# Altium schematic sheet Array.SchDoc (part 2 of 3)
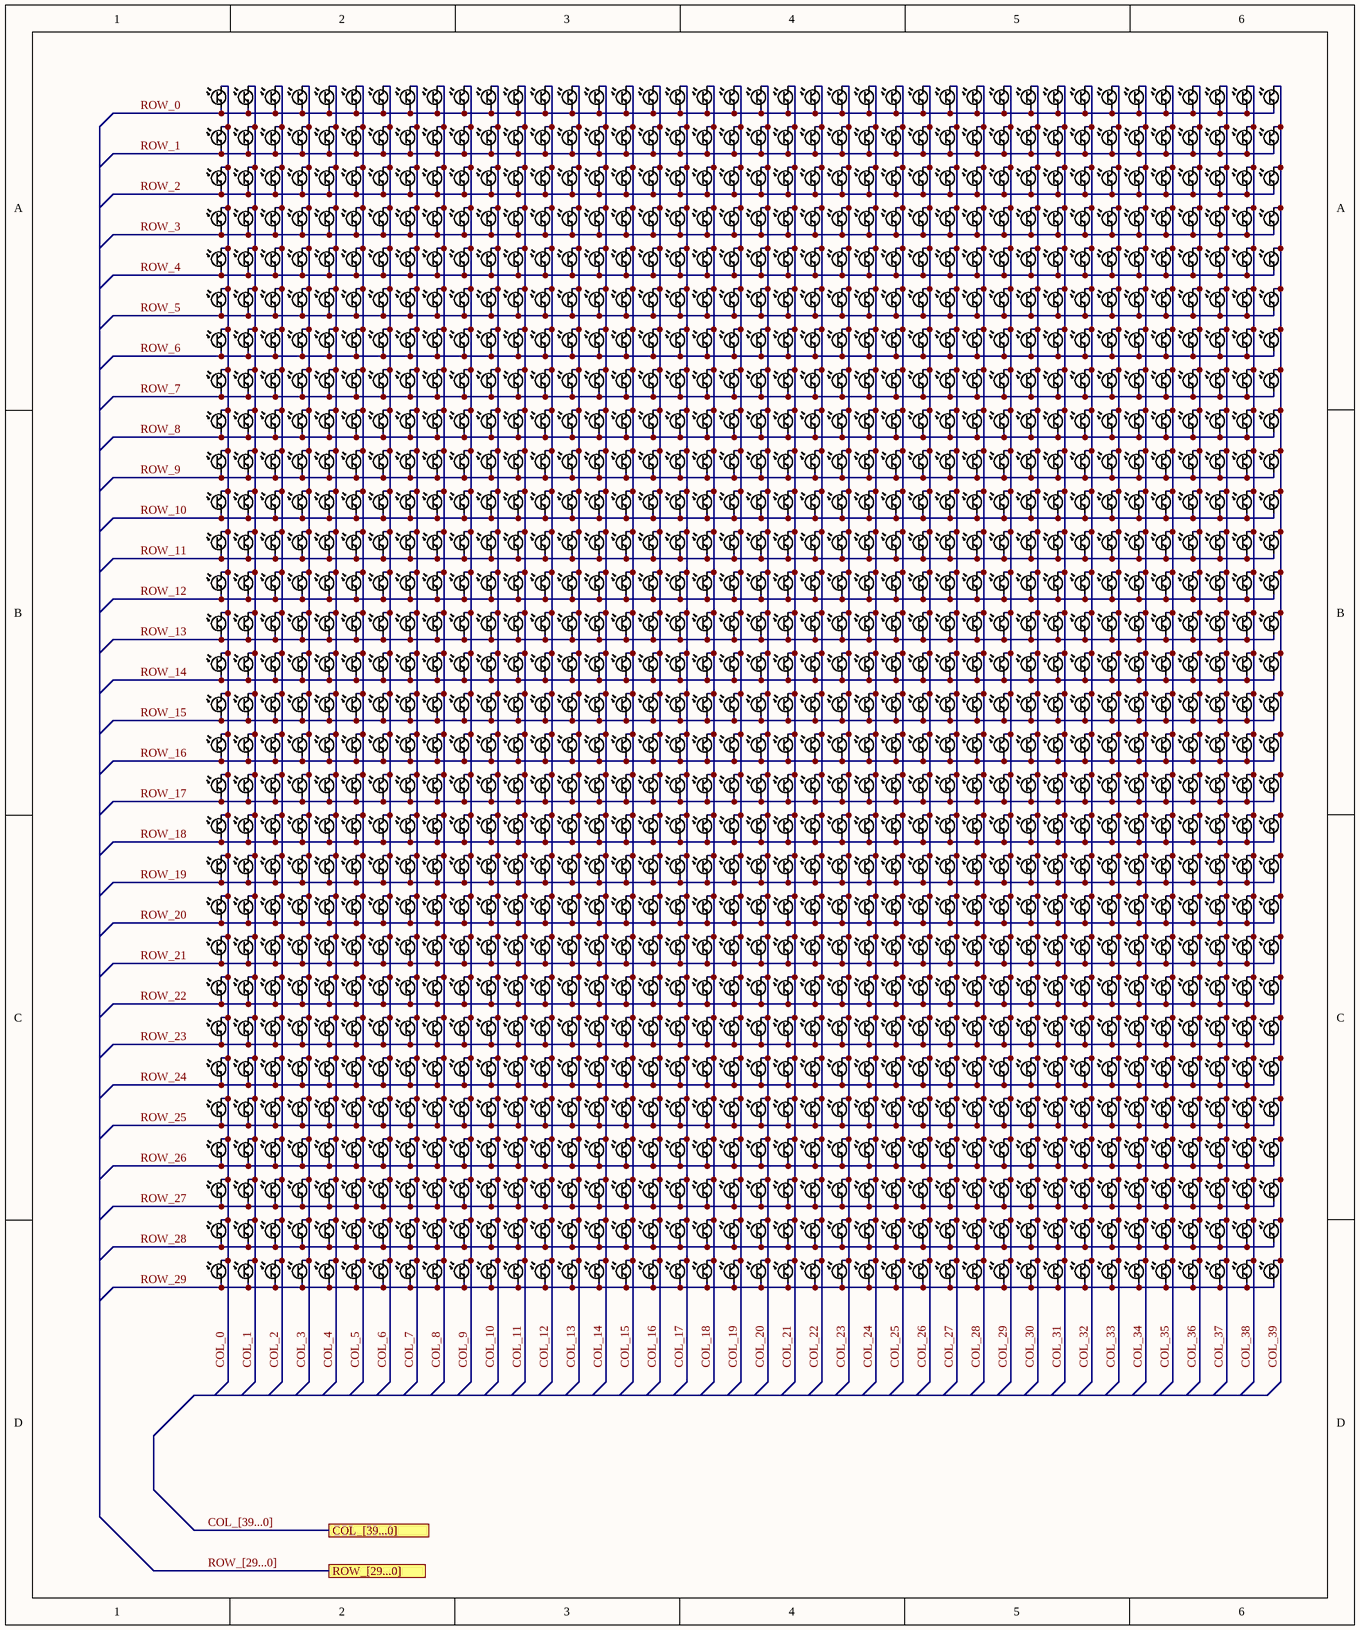
[diagram p1: Array.SchDoc]
## Parts
Q1  PT0805CS  [0805 Phototransistor]  (value not drawn)
Q2  PT0805CS  [0805 Phototransistor]  (value not drawn)
Q3  PT0805CS  [0805 Phototransistor]  (value not drawn)
Q4  PT0805CS  [0805 Phototransistor]  (value not drawn)
Q5  PT0805CS  [0805 Phototransistor]  (value not drawn)
Q6  PT0805CS  [0805 Phototransistor]  (value not drawn)
Q7  PT0805CS  [0805 Phototransistor]  (value not drawn)
Q8  PT0805CS  [0805 Phototransistor]  (value not drawn)
Q9  PT0805CS  [0805 Phototransistor]  (value not drawn)
Q10  PT0805CS  [0805 Phototransistor]  (value not drawn)
Q11  PT0805CS  [0805 Phototransistor]  (value not drawn)
Q12  PT0805CS  [0805 Phototransistor]  (value not drawn)
Q13  PT0805CS  [0805 Phototransistor]  (value not drawn)
Q14  PT0805CS  [0805 Phototransistor]  (value not drawn)
Q15  PT0805CS  [0805 Phototransistor]  (value not drawn)
Q16  PT0805CS  [0805 Phototransistor]  (value not drawn)
Q17  PT0805CS  [0805 Phototransistor]  (value not drawn)
Q18  PT0805CS  [0805 Phototransistor]  (value not drawn)
Q19  PT0805CS  [0805 Phototransistor]  (value not drawn)
Q20  PT0805CS  [0805 Phototransistor]  (value not drawn)
Q21  PT0805CS  [0805 Phototransistor]  (value not drawn)
Q22  PT0805CS  [0805 Phototransistor]  (value not drawn)
Q23  PT0805CS  [0805 Phototransistor]  (value not drawn)
Q24  PT0805CS  [0805 Phototransistor]  (value not drawn)
Q25  PT0805CS  [0805 Phototransistor]  (value not drawn)
Q26  PT0805CS  [0805 Phototransistor]  (value not drawn)
Q27  PT0805CS  [0805 Phototransistor]  (value not drawn)
Q28  PT0805CS  [0805 Phototransistor]  (value not drawn)
Q29  PT0805CS  [0805 Phototransistor]  (value not drawn)
Q30  PT0805CS  [0805 Phototransistor]  (value not drawn)
Q31  PT0805CS  [0805 Phototransistor]  (value not drawn)
Q32  PT0805CS  [0805 Phototransistor]  (value not drawn)
Q33  PT0805CS  [0805 Phototransistor]  (value not drawn)
Q34  PT0805CS  [0805 Phototransistor]  (value not drawn)
Q35  PT0805CS  [0805 Phototransistor]  (value not drawn)
Q36  PT0805CS  [0805 Phototransistor]  (value not drawn)
Q37  PT0805CS  [0805 Phototransistor]  (value not drawn)
Q38  PT0805CS  [0805 Phototransistor]  (value not drawn)
Q39  PT0805CS  [0805 Phototransistor]  (value not drawn)
Q40  PT0805CS  [0805 Phototransistor]  (value not drawn)
Q41  PT0805CS  [0805 Phototransistor]  (value not drawn)
Q42  PT0805CS  [0805 Phototransistor]  (value not drawn)
Q43  PT0805CS  [0805 Phototransistor]  (value not drawn)
Q44  PT0805CS  [0805 Phototransistor]  (value not drawn)
Q45  PT0805CS  [0805 Phototransistor]  (value not drawn)
Q46  PT0805CS  [0805 Phototransistor]  (value not drawn)
Q47  PT0805CS  [0805 Phototransistor]  (value not drawn)
Q48  PT0805CS  [0805 Phototransistor]  (value not drawn)
Q49  PT0805CS  [0805 Phototransistor]  (value not drawn)
Q50  PT0805CS  [0805 Phototransistor]  (value not drawn)
Q51  PT0805CS  [0805 Phototransistor]  (value not drawn)
Q52  PT0805CS  [0805 Phototransistor]  (value not drawn)
Q53  PT0805CS  [0805 Phototransistor]  (value not drawn)
Q54  PT0805CS  [0805 Phototransistor]  (value not drawn)
Q55  PT0805CS  [0805 Phototransistor]  (value not drawn)
Q56  PT0805CS  [0805 Phototransistor]  (value not drawn)
Q57  PT0805CS  [0805 Phototransistor]  (value not drawn)
Q58  PT0805CS  [0805 Phototransistor]  (value not drawn)
Q59  PT0805CS  [0805 Phototransistor]  (value not drawn)
Q60  PT0805CS  [0805 Phototransistor]  (value not drawn)
Q61  PT0805CS  [0805 Phototransistor]  (value not drawn)
Q62  PT0805CS  [0805 Phototransistor]  (value not drawn)
Q63  PT0805CS  [0805 Phototransistor]  (value not drawn)
Q64  PT0805CS  [0805 Phototransistor]  (value not drawn)
Q65  PT0805CS  [0805 Phototransistor]  (value not drawn)
Q66  PT0805CS  [0805 Phototransistor]  (value not drawn)
Q67  PT0805CS  [0805 Phototransistor]  (value not drawn)
Q68  PT0805CS  [0805 Phototransistor]  (value not drawn)
Q69  PT0805CS  [0805 Phototransistor]  (value not drawn)
Q70  PT0805CS  [0805 Phototransistor]  (value not drawn)
Q71  PT0805CS  [0805 Phototransistor]  (value not drawn)
Q72  PT0805CS  [0805 Phototransistor]  (value not drawn)
Q73  PT0805CS  [0805 Phototransistor]  (value not drawn)
Q74  PT0805CS  [0805 Phototransistor]  (value not drawn)
Q75  PT0805CS  [0805 Phototransistor]  (value not drawn)
Q76  PT0805CS  [0805 Phototransistor]  (value not drawn)
Q77  PT0805CS  [0805 Phototransistor]  (value not drawn)
Q78  PT0805CS  [0805 Phototransistor]  (value not drawn)
Q79  PT0805CS  [0805 Phototransistor]  (value not drawn)
Q80  PT0805CS  [0805 Phototransistor]  (value not drawn)
Q81  PT0805CS  [0805 Phototransistor]  (value not drawn)
Q82  PT0805CS  [0805 Phototransistor]  (value not drawn)
Q83  PT0805CS  [0805 Phototransistor]  (value not drawn)
Q84  PT0805CS  [0805 Phototransistor]  (value not drawn)
Q85  PT0805CS  [0805 Phototransistor]  (value not drawn)
Q86  PT0805CS  [0805 Phototransistor]  (value not drawn)
Q87  PT0805CS  [0805 Phototransistor]  (value not drawn)
Q88  PT0805CS  [0805 Phototransistor]  (value not drawn)
Q89  PT0805CS  [0805 Phototransistor]  (value not drawn)
Q90  PT0805CS  [0805 Phototransistor]  (value not drawn)
Q91  PT0805CS  [0805 Phototransistor]  (value not drawn)
Q92  PT0805CS  [0805 Phototransistor]  (value not drawn)
Q93  PT0805CS  [0805 Phototransistor]  (value not drawn)
Q94  PT0805CS  [0805 Phototransistor]  (value not drawn)
Q95  PT0805CS  [0805 Phototransistor]  (value not drawn)
Q96  PT0805CS  [0805 Phototransistor]  (value not drawn)
Q97  PT0805CS  [0805 Phototransistor]  (value not drawn)
Q98  PT0805CS  [0805 Phototransistor]  (value not drawn)
Q99  PT0805CS  [0805 Phototransistor]  (value not drawn)
Q100  PT0805CS  [0805 Phototransistor]  (value not drawn)
Q101  PT0805CS  [0805 Phototransistor]  (value not drawn)
Q102  PT0805CS  [0805 Phototransistor]  (value not drawn)
Q103  PT0805CS  [0805 Phototransistor]  (value not drawn)
Q104  PT0805CS  [0805 Phototransistor]  (value not drawn)
Q105  PT0805CS  [0805 Phototransistor]  (value not drawn)
Q106  PT0805CS  [0805 Phototransistor]  (value not drawn)
Q107  PT0805CS  [0805 Phototransistor]  (value not drawn)
Q108  PT0805CS  [0805 Phototransistor]  (value not drawn)
Q109  PT0805CS  [0805 Phototransistor]  (value not drawn)
Q110  PT0805CS  [0805 Phototransistor]  (value not drawn)
Q111  PT0805CS  [0805 Phototransistor]  (value not drawn)
Q112  PT0805CS  [0805 Phototransistor]  (value not drawn)
Q113  PT0805CS  [0805 Phototransistor]  (value not drawn)
Q114  PT0805CS  [0805 Phototransistor]  (value not drawn)
Q115  PT0805CS  [0805 Phototransistor]  (value not drawn)
Q116  PT0805CS  [0805 Phototransistor]  (value not drawn)
Q117  PT0805CS  [0805 Phototransistor]  (value not drawn)
Q118  PT0805CS  [0805 Phototransistor]  (value not drawn)
Q119  PT0805CS  [0805 Phototransistor]  (value not drawn)
Q120  PT0805CS  [0805 Phototransistor]  (value not drawn)
Q121  PT0805CS  [0805 Phototransistor]  (value not drawn)
Q122  PT0805CS  [0805 Phototransistor]  (value not drawn)
Q123  PT0805CS  [0805 Phototransistor]  (value not drawn)
Q124  PT0805CS  [0805 Phototransistor]  (value not drawn)
Q125  PT0805CS  [0805 Phototransistor]  (value not drawn)
Q126  PT0805CS  [0805 Phototransistor]  (value not drawn)
Q127  PT0805CS  [0805 Phototransistor]  (value not drawn)
Q128  PT0805CS  [0805 Phototransistor]  (value not drawn)
Q129  PT0805CS  [0805 Phototransistor]  (value not drawn)
Q130  PT0805CS  [0805 Phototransistor]  (value not drawn)
Q131  PT0805CS  [0805 Phototransistor]  (value not drawn)
Q132  PT0805CS  [0805 Phototransistor]  (value not drawn)
Q133  PT0805CS  [0805 Phototransistor]  (value not drawn)
Q134  PT0805CS  [0805 Phototransistor]  (value not drawn)
Q135  PT0805CS  [0805 Phototransistor]  (value not drawn)
Q136  PT0805CS  [0805 Phototransistor]  (value not drawn)
Q137  PT0805CS  [0805 Phototransistor]  (value not drawn)
Q138  PT0805CS  [0805 Phototransistor]  (value not drawn)
Q139  PT0805CS  [0805 Phototransistor]  (value not drawn)
Q140  PT0805CS  [0805 Phototransistor]  (value not drawn)
Q141  PT0805CS  [0805 Phototransistor]  (value not drawn)
Q142  PT0805CS  [0805 Phototransistor]  (value not drawn)
Q143  PT0805CS  [0805 Phototransistor]  (value not drawn)
Q144  PT0805CS  [0805 Phototransistor]  (value not drawn)
Q145  PT0805CS  [0805 Phototransistor]  (value not drawn)
Q146  PT0805CS  [0805 Phototransistor]  (value not drawn)
Q147  PT0805CS  [0805 Phototransistor]  (value not drawn)
Q148  PT0805CS  [0805 Phototransistor]  (value not drawn)
Q149  PT0805CS  [0805 Phototransistor]  (value not drawn)
Q150  PT0805CS  [0805 Phototransistor]  (value not drawn)
Q151  PT0805CS  [0805 Phototransistor]  (value not drawn)
Q152  PT0805CS  [0805 Phototransistor]  (value not drawn)
Q153  PT0805CS  [0805 Phototransistor]  (value not drawn)
Q154  PT0805CS  [0805 Phototransistor]  (value not drawn)
Q155  PT0805CS  [0805 Phototransistor]  (value not drawn)
Q156  PT0805CS  [0805 Phototransistor]  (value not drawn)
Q157  PT0805CS  [0805 Phototransistor]  (value not drawn)
Q158  PT0805CS  [0805 Phototransistor]  (value not drawn)
Q159  PT0805CS  [0805 Phototransistor]  (value not drawn)
Q160  PT0805CS  [0805 Phototransistor]  (value not drawn)
Q161  PT0805CS  [0805 Phototransistor]  (value not drawn)
Q162  PT0805CS  [0805 Phototransistor]  (value not drawn)
Q163  PT0805CS  [0805 Phototransistor]  (value not drawn)
Q164  PT0805CS  [0805 Phototransistor]  (value not drawn)
Q165  PT0805CS  [0805 Phototransistor]  (value not drawn)
Q166  PT0805CS  [0805 Phototransistor]  (value not drawn)
Q167  PT0805CS  [0805 Phototransistor]  (value not drawn)
Q168  PT0805CS  [0805 Phototransistor]  (value not drawn)
Q169  PT0805CS  [0805 Phototransistor]  (value not drawn)
Q170  PT0805CS  [0805 Phototransistor]  (value not drawn)
Q171  PT0805CS  [0805 Phototransistor]  (value not drawn)
Q172  PT0805CS  [0805 Phototransistor]  (value not drawn)
Q173  PT0805CS  [0805 Phototransistor]  (value not drawn)
Q174  PT0805CS  [0805 Phototransistor]  (value not drawn)
Q175  PT0805CS  [0805 Phototransistor]  (value not drawn)
Q176  PT0805CS  [0805 Phototransistor]  (value not drawn)
Q177  PT0805CS  [0805 Phototransistor]  (value not drawn)
Q178  PT0805CS  [0805 Phototransistor]  (value not drawn)
Q179  PT0805CS  [0805 Phototransistor]  (value not drawn)
Q180  PT0805CS  [0805 Phototransistor]  (value not drawn)
Q181  PT0805CS  [0805 Phototransistor]  (value not drawn)
Q182  PT0805CS  [0805 Phototransistor]  (value not drawn)
Q183  PT0805CS  [0805 Phototransistor]  (value not drawn)
Q184  PT0805CS  [0805 Phototransistor]  (value not drawn)
Q185  PT0805CS  [0805 Phototransistor]  (value not drawn)
Q186  PT0805CS  [0805 Phototransistor]  (value not drawn)
Q187  PT0805CS  [0805 Phototransistor]  (value not drawn)
Q188  PT0805CS  [0805 Phototransistor]  (value not drawn)
Q189  PT0805CS  [0805 Phototransistor]  (value not drawn)
Q190  PT0805CS  [0805 Phototransistor]  (value not drawn)
Q191  PT0805CS  [0805 Phototransistor]  (value not drawn)
Q192  PT0805CS  [0805 Phototransistor]  (value not drawn)
Q193  PT0805CS  [0805 Phototransistor]  (value not drawn)
Q194  PT0805CS  [0805 Phototransistor]  (value not drawn)
Q195  PT0805CS  [0805 Phototransistor]  (value not drawn)
Q196  PT0805CS  [0805 Phototransistor]  (value not drawn)
Q197  PT0805CS  [0805 Phototransistor]  (value not drawn)
Q198  PT0805CS  [0805 Phototransistor]  (value not drawn)
Q199  PT0805CS  [0805 Phototransistor]  (value not drawn)
Q200  PT0805CS  [0805 Phototransistor]  (value not drawn)
Q201  PT0805CS  [0805 Phototransistor]  (value not drawn)
Q202  PT0805CS  [0805 Phototransistor]  (value not drawn)
Q203  PT0805CS  [0805 Phototransistor]  (value not drawn)
Q204  PT0805CS  [0805 Phototransistor]  (value not drawn)
Q205  PT0805CS  [0805 Phototransistor]  (value not drawn)
Q206  PT0805CS  [0805 Phototransistor]  (value not drawn)
Q207  PT0805CS  [0805 Phototransistor]  (value not drawn)
Q208  PT0805CS  [0805 Phototransistor]  (value not drawn)
Q209  PT0805CS  [0805 Phototransistor]  (value not drawn)
Q210  PT0805CS  [0805 Phototransistor]  (value not drawn)
Q211  PT0805CS  [0805 Phototransistor]  (value not drawn)
Q212  PT0805CS  [0805 Phototransistor]  (value not drawn)
Q213  PT0805CS  [0805 Phototransistor]  (value not drawn)
Q214  PT0805CS  [0805 Phototransistor]  (value not drawn)
Q215  PT0805CS  [0805 Phototransistor]  (value not drawn)
Q216  PT0805CS  [0805 Phototransistor]  (value not drawn)
Q217  PT0805CS  [0805 Phototransistor]  (value not drawn)
Q218  PT0805CS  [0805 Phototransistor]  (value not drawn)
Q219  PT0805CS  [0805 Phototransistor]  (value not drawn)
Q220  PT0805CS  [0805 Phototransistor]  (value not drawn)
Q221  PT0805CS  [0805 Phototransistor]  (value not drawn)
Q222  PT0805CS  [0805 Phototransistor]  (value not drawn)
Q223  PT0805CS  [0805 Phototransistor]  (value not drawn)
Q224  PT0805CS  [0805 Phototransistor]  (value not drawn)
Q225  PT0805CS  [0805 Phototransistor]  (value not drawn)
Q226  PT0805CS  [0805 Phototransistor]  (value not drawn)
Q227  PT0805CS  [0805 Phototransistor]  (value not drawn)
Q228  PT0805CS  [0805 Phototransistor]  (value not drawn)
Q229  PT0805CS  [0805 Phototransistor]  (value not drawn)
Q230  PT0805CS  [0805 Phototransistor]  (value not drawn)
Q231  PT0805CS  [0805 Phototransistor]  (value not drawn)
Q232  PT0805CS  [0805 Phototransistor]  (value not drawn)
Q233  PT0805CS  [0805 Phototransistor]  (value not drawn)
Q234  PT0805CS  [0805 Phototransistor]  (value not drawn)
Q235  PT0805CS  [0805 Phototransistor]  (value not drawn)
Q236  PT0805CS  [0805 Phototransistor]  (value not drawn)
Q237  PT0805CS  [0805 Phototransistor]  (value not drawn)
Q238  PT0805CS  [0805 Phototransistor]  (value not drawn)
Q239  PT0805CS  [0805 Phototransistor]  (value not drawn)
Q240  PT0805CS  [0805 Phototransistor]  (value not drawn)
Q241  PT0805CS  [0805 Phototransistor]  (value not drawn)
Q242  PT0805CS  [0805 Phototransistor]  (value not drawn)
Q243  PT0805CS  [0805 Phototransistor]  (value not drawn)
Q244  PT0805CS  [0805 Phototransistor]  (value not drawn)
Q245  PT0805CS  [0805 Phototransistor]  (value not drawn)
Q246  PT0805CS  [0805 Phototransistor]  (value not drawn)
Q247  PT0805CS  [0805 Phototransistor]  (value not drawn)
Q248  PT0805CS  [0805 Phototransistor]  (value not drawn)
Q249  PT0805CS  [0805 Phototransistor]  (value not drawn)
Q250  PT0805CS  [0805 Phototransistor]  (value not drawn)
Q251  PT0805CS  [0805 Phototransistor]  (value not drawn)
Q252  PT0805CS  [0805 Phototransistor]  (value not drawn)
Q253  PT0805CS  [0805 Phototransistor]  (value not drawn)
Q254  PT0805CS  [0805 Phototransistor]  (value not drawn)
Q255  PT0805CS  [0805 Phototransistor]  (value not drawn)
Q256  PT0805CS  [0805 Phototransistor]  (value not drawn)
Q257  PT0805CS  [0805 Phototransistor]  (value not drawn)
Q258  PT0805CS  [0805 Phototransistor]  (value not drawn)
Q259  PT0805CS  [0805 Phototransistor]  (value not drawn)
Q260  PT0805CS  [0805 Phototransistor]  (value not drawn)
Q261  PT0805CS  [0805 Phototransistor]  (value not drawn)
Q262  PT0805CS  [0805 Phototransistor]  (value not drawn)
Q263  PT0805CS  [0805 Phototransistor]  (value not drawn)
Q264  PT0805CS  [0805 Phototransistor]  (value not drawn)
Q265  PT0805CS  [0805 Phototransistor]  (value not drawn)
Q266  PT0805CS  [0805 Phototransistor]  (value not drawn)
Q267  PT0805CS  [0805 Phototransistor]  (value not drawn)
Q268  PT0805CS  [0805 Phototransistor]  (value not drawn)
Q269  PT0805CS  [0805 Phototransistor]  (value not drawn)
Q270  PT0805CS  [0805 Phototransistor]  (value not drawn)
Q271  PT0805CS  [0805 Phototransistor]  (value not drawn)
Q272  PT0805CS  [0805 Phototransistor]  (value not drawn)
Q273  PT0805CS  [0805 Phototransistor]  (value not drawn)
Q274  PT0805CS  [0805 Phototransistor]  (value not drawn)
Q275  PT0805CS  [0805 Phototransistor]  (value not drawn)
Q276  PT0805CS  [0805 Phototransistor]  (value not drawn)
Q277  PT0805CS  [0805 Phototransistor]  (value not drawn)
Q278  PT0805CS  [0805 Phototransistor]  (value not drawn)
Q279  PT0805CS  [0805 Phototransistor]  (value not drawn)
Q280  PT0805CS  [0805 Phototransistor]  (value not drawn)
Q281  PT0805CS  [0805 Phototransistor]  (value not drawn)
Q282  PT0805CS  [0805 Phototransistor]  (value not drawn)
Q283  PT0805CS  [0805 Phototransistor]  (value not drawn)
Q284  PT0805CS  [0805 Phototransistor]  (value not drawn)
Q285  PT0805CS  [0805 Phototransistor]  (value not drawn)
Q286  PT0805CS  [0805 Phototransistor]  (value not drawn)
Q287  PT0805CS  [0805 Phototransistor]  (value not drawn)
Q288  PT0805CS  [0805 Phototransistor]  (value not drawn)
Q289  PT0805CS  [0805 Phototransistor]  (value not drawn)
Q290  PT0805CS  [0805 Phototransistor]  (value not drawn)
Q291  PT0805CS  [0805 Phototransistor]  (value not drawn)
Q292  PT0805CS  [0805 Phototransistor]  (value not drawn)
Q293  PT0805CS  [0805 Phototransistor]  (value not drawn)
Q294  PT0805CS  [0805 Phototransistor]  (value not drawn)
Q295  PT0805CS  [0805 Phototransistor]  (value not drawn)
Q296  PT0805CS  [0805 Phototransistor]  (value not drawn)
Q297  PT0805CS  [0805 Phototransistor]  (value not drawn)
Q298  PT0805CS  [0805 Phototransistor]  (value not drawn)
Q299  PT0805CS  [0805 Phototransistor]  (value not drawn)
Q300  PT0805CS  [0805 Phototransistor]  (value not drawn)
Q301  PT0805CS  [0805 Phototransistor]  (value not drawn)
Q302  PT0805CS  [0805 Phototransistor]  (value not drawn)
Q303  PT0805CS  [0805 Phototransistor]  (value not drawn)
Q304  PT0805CS  [0805 Phototransistor]  (value not drawn)
Q305  PT0805CS  [0805 Phototransistor]  (value not drawn)
Q306  PT0805CS  [0805 Phototransistor]  (value not drawn)
Q307  PT0805CS  [0805 Phototransistor]  (value not drawn)
Q308  PT0805CS  [0805 Phototransistor]  (value not drawn)
Q309  PT0805CS  [0805 Phototransistor]  (value not drawn)
Q310  PT0805CS  [0805 Phototransistor]  (value not drawn)
Q311  PT0805CS  [0805 Phototransistor]  (value not drawn)
Q312  PT0805CS  [0805 Phototransistor]  (value not drawn)
Q313  PT0805CS  [0805 Phototransistor]  (value not drawn)
Q314  PT0805CS  [0805 Phototransistor]  (value not drawn)
Q315  PT0805CS  [0805 Phototransistor]  (value not drawn)
Q316  PT0805CS  [0805 Phototransistor]  (value not drawn)
Q317  PT0805CS  [0805 Phototransistor]  (value not drawn)
Q318  PT0805CS  [0805 Phototransistor]  (value not drawn)
Q319  PT0805CS  [0805 Phototransistor]  (value not drawn)
Q320  PT0805CS  [0805 Phototransistor]  (value not drawn)
Q321  PT0805CS  [0805 Phototransistor]  (value not drawn)
Q322  PT0805CS  [0805 Phototransistor]  (value not drawn)
Q323  PT0805CS  [0805 Phototransistor]  (value not drawn)
Q324  PT0805CS  [0805 Phototransistor]  (value not drawn)
Q325  PT0805CS  [0805 Phototransistor]  (value not drawn)
Q326  PT0805CS  [0805 Phototransistor]  (value not drawn)
Q327  PT0805CS  [0805 Phototransistor]  (value not drawn)
Q328  PT0805CS  [0805 Phototransistor]  (value not drawn)
Q329  PT0805CS  [0805 Phototransistor]  (value not drawn)
Q330  PT0805CS  [0805 Phototransistor]  (value not drawn)
Q331  PT0805CS  [0805 Phototransistor]  (value not drawn)
Q332  PT0805CS  [0805 Phototransistor]  (value not drawn)
Q333  PT0805CS  [0805 Phototransistor]  (value not drawn)
Q334  PT0805CS  [0805 Phototransistor]  (value not drawn)
Q335  PT0805CS  [0805 Phototransistor]  (value not drawn)
Q336  PT0805CS  [0805 Phototransistor]  (value not drawn)
Q337  PT0805CS  [0805 Phototransistor]  (value not drawn)
Q338  PT0805CS  [0805 Phototransistor]  (value not drawn)
Q339  PT0805CS  [0805 Phototransistor]  (value not drawn)
Q340  PT0805CS  [0805 Phototransistor]  (value not drawn)
Q341  PT0805CS  [0805 Phototransistor]  (value not drawn)
Q342  PT0805CS  [0805 Phototransistor]  (value not drawn)
Q343  PT0805CS  [0805 Phototransistor]  (value not drawn)
Q344  PT0805CS  [0805 Phototransistor]  (value not drawn)
Q345  PT0805CS  [0805 Phototransistor]  (value not drawn)
Q346  PT0805CS  [0805 Phototransistor]  (value not drawn)
Q347  PT0805CS  [0805 Phototransistor]  (value not drawn)
Q348  PT0805CS  [0805 Phototransistor]  (value not drawn)
Q349  PT0805CS  [0805 Phototransistor]  (value not drawn)
Q350  PT0805CS  [0805 Phototransistor]  (value not drawn)
Q351  PT0805CS  [0805 Phototransistor]  (value not drawn)
Q352  PT0805CS  [0805 Phototransistor]  (value not drawn)
Q353  PT0805CS  [0805 Phototransistor]  (value not drawn)
Q354  PT0805CS  [0805 Phototransistor]  (value not drawn)
Q355  PT0805CS  [0805 Phototransistor]  (value not drawn)
Q356  PT0805CS  [0805 Phototransistor]  (value not drawn)
Q357  PT0805CS  [0805 Phototransistor]  (value not drawn)
Q358  PT0805CS  [0805 Phototransistor]  (value not drawn)
Q359  PT0805CS  [0805 Phototransistor]  (value not drawn)
Q360  PT0805CS  [0805 Phototransistor]  (value not drawn)
Q361  PT0805CS  [0805 Phototransistor]  (value not drawn)
Q362  PT0805CS  [0805 Phototransistor]  (value not drawn)
Q363  PT0805CS  [0805 Phototransistor]  (value not drawn)
Q364  PT0805CS  [0805 Phototransistor]  (value not drawn)
Q365  PT0805CS  [0805 Phototransistor]  (value not drawn)
Q366  PT0805CS  [0805 Phototransistor]  (value not drawn)
Q367  PT0805CS  [0805 Phototransistor]  (value not drawn)
Q368  PT0805CS  [0805 Phototransistor]  (value not drawn)
Q369  PT0805CS  [0805 Phototransistor]  (value not drawn)
Q370  PT0805CS  [0805 Phototransistor]  (value not drawn)
Q371  PT0805CS  [0805 Phototransistor]  (value not drawn)
Q372  PT0805CS  [0805 Phototransistor]  (value not drawn)
Q373  PT0805CS  [0805 Phototransistor]  (value not drawn)
Q374  PT0805CS  [0805 Phototransistor]  (value not drawn)
Q375  PT0805CS  [0805 Phototransistor]  (value not drawn)
Q376  PT0805CS  [0805 Phototransistor]  (value not drawn)
Q377  PT0805CS  [0805 Phototransistor]  (value not drawn)
Q378  PT0805CS  [0805 Phototransistor]  (value not drawn)
Q379  PT0805CS  [0805 Phototransistor]  (value not drawn)
Q380  PT0805CS  [0805 Phototransistor]  (value not drawn)
Q381  PT0805CS  [0805 Phototransistor]  (value not drawn)
Q382  PT0805CS  [0805 Phototransistor]  (value not drawn)
Q383  PT0805CS  [0805 Phototransistor]  (value not drawn)
Q384  PT0805CS  [0805 Phototransistor]  (value not drawn)
Q385  PT0805CS  [0805 Phototransistor]  (value not drawn)
Q386  PT0805CS  [0805 Phototransistor]  (value not drawn)
Q387  PT0805CS  [0805 Phototransistor]  (value not drawn)
Q388  PT0805CS  [0805 Phototransistor]  (value not drawn)
Q389  PT0805CS  [0805 Phototransistor]  (value not drawn)
Q390  PT0805CS  [0805 Phototransistor]  (value not drawn)
Q391  PT0805CS  [0805 Phototransistor]  (value not drawn)
Q392  PT0805CS  [0805 Phototransistor]  (value not drawn)
Q393  PT0805CS  [0805 Phototransistor]  (value not drawn)
Q394  PT0805CS  [0805 Phototransistor]  (value not drawn)
Q395  PT0805CS  [0805 Phototransistor]  (value not drawn)
Q396  PT0805CS  [0805 Phototransistor]  (value not drawn)
Q397  PT0805CS  [0805 Phototransistor]  (value not drawn)
Q398  PT0805CS  [0805 Phototransistor]  (value not drawn)
Q399  PT0805CS  [0805 Phototransistor]  (value not drawn)
Q400  PT0805CS  [0805 Phototransistor]  (value not drawn)
Q401  PT0805CS  [0805 Phototransistor]  (value not drawn)
Q402  PT0805CS  [0805 Phototransistor]  (value not drawn)
Q403  PT0805CS  [0805 Phototransistor]  (value not drawn)
Q404  PT0805CS  [0805 Phototransistor]  (value not drawn)
Q405  PT0805CS  [0805 Phototransistor]  (value not drawn)
Q406  PT0805CS  [0805 Phototransistor]  (value not drawn)
Q407  PT0805CS  [0805 Phototransistor]  (value not drawn)
Q408  PT0805CS  [0805 Phototransistor]  (value not drawn)
Q409  PT0805CS  [0805 Phototransistor]  (value not drawn)
Q410  PT0805CS  [0805 Phototransistor]  (value not drawn)
Q411  PT0805CS  [0805 Phototransistor]  (value not drawn)
Q412  PT0805CS  [0805 Phototransistor]  (value not drawn)
Q413  PT0805CS  [0805 Phototransistor]  (value not drawn)
Q414  PT0805CS  [0805 Phototransistor]  (value not drawn)
Q415  PT0805CS  [0805 Phototransistor]  (value not drawn)
Q416  PT0805CS  [0805 Phototransistor]  (value not drawn)
Q417  PT0805CS  [0805 Phototransistor]  (value not drawn)
Q418  PT0805CS  [0805 Phototransistor]  (value not drawn)
Q419  PT0805CS  [0805 Phototransistor]  (value not drawn)
Q420  PT0805CS  [0805 Phototransistor]  (value not drawn)
Q421  PT0805CS  [0805 Phototransistor]  (value not drawn)
Q422  PT0805CS  [0805 Phototransistor]  (value not drawn)
Q423  PT0805CS  [0805 Phototransistor]  (value not drawn)
Q424  PT0805CS  [0805 Phototransistor]  (value not drawn)
Q425  PT0805CS  [0805 Phototransistor]  (value not drawn)
Q426  PT0805CS  [0805 Phototransistor]  (value not drawn)
Q427  PT0805CS  [0805 Phototransistor]  (value not drawn)
Q428  PT0805CS  [0805 Phototransistor]  (value not drawn)
Q429  PT0805CS  [0805 Phototransistor]  (value not drawn)
Q430  PT0805CS  [0805 Phototransistor]  (value not drawn)
Q431  PT0805CS  [0805 Phototransistor]  (value not drawn)
Q432  PT0805CS  [0805 Phototransistor]  (value not drawn)
Q433  PT0805CS  [0805 Phototransistor]  (value not drawn)
Q434  PT0805CS  [0805 Phototransistor]  (value not drawn)
Q435  PT0805CS  [0805 Phototransistor]  (value not drawn)
Q436  PT0805CS  [0805 Phototransistor]  (value not drawn)
Q437  PT0805CS  [0805 Phototransistor]  (value not drawn)
Q438  PT0805CS  [0805 Phototransistor]  (value not drawn)
Q439  PT0805CS  [0805 Phototransistor]  (value not drawn)
Q440  PT0805CS  [0805 Phototransistor]  (value not drawn)
Q441  PT0805CS  [0805 Phototransistor]  (value not drawn)
Q442  PT0805CS  [0805 Phototransistor]  (value not drawn)
Q443  PT0805CS  [0805 Phototransistor]  (value not drawn)
Q444  PT0805CS  [0805 Phototransistor]  (value not drawn)
Q445  PT0805CS  [0805 Phototransistor]  (value not drawn)
Q446  PT0805CS  [0805 Phototransistor]  (value not drawn)
Q447  PT0805CS  [0805 Phototransistor]  (value not drawn)
Q448  PT0805CS  [0805 Phototransistor]  (value not drawn)
Q449  PT0805CS  [0805 Phototransistor]  (value not drawn)
Q450  PT0805CS  [0805 Phototransistor]  (value not drawn)
Q451  PT0805CS  [0805 Phototransistor]  (value not drawn)
Q452  PT0805CS  [0805 Phototransistor]  (value not drawn)
Q453  PT0805CS  [0805 Phototransistor]  (value not drawn)
Q454  PT0805CS  [0805 Phototransistor]  (value not drawn)
Q455  PT0805CS  [0805 Phototransistor]  (value not drawn)
Q456  PT0805CS  [0805 Phototransistor]  (value not drawn)
Q457  PT0805CS  [0805 Phototransistor]  (value not drawn)
Q458  PT0805CS  [0805 Phototransistor]  (value not drawn)
Q459  PT0805CS  [0805 Phototransistor]  (value not drawn)
Q460  PT0805CS  [0805 Phototransistor]  (value not drawn)
Q461  PT0805CS  [0805 Phototransistor]  (value not drawn)
Q462  PT0805CS  [0805 Phototransistor]  (value not drawn)
Q463  PT0805CS  [0805 Phototransistor]  (value not drawn)
Q464  PT0805CS  [0805 Phototransistor]  (value not drawn)
Q465  PT0805CS  [0805 Phototransistor]  (value not drawn)
Q466  PT0805CS  [0805 Phototransistor]  (value not drawn)
Q467  PT0805CS  [0805 Phototransistor]  (value not drawn)
Q468  PT0805CS  [0805 Phototransistor]  (value not drawn)
Q469  PT0805CS  [0805 Phototransistor]  (value not drawn)
Q470  PT0805CS  [0805 Phototransistor]  (value not drawn)
Q471  PT0805CS  [0805 Phototransistor]  (value not drawn)
Q472  PT0805CS  [0805 Phototransistor]  (value not drawn)
Q473  PT0805CS  [0805 Phototransistor]  (value not drawn)
Q474  PT0805CS  [0805 Phototransistor]  (value not drawn)
Q475  PT0805CS  [0805 Phototransistor]  (value not drawn)
Q476  PT0805CS  [0805 Phototransistor]  (value not drawn)
Q477  PT0805CS  [0805 Phototransistor]  (value not drawn)
Q478  PT0805CS  [0805 Phototransistor]  (value not drawn)
Q479  PT0805CS  [0805 Phototransistor]  (value not drawn)
Q480  PT0805CS  [0805 Phototransistor]  (value not drawn)
Q481  PT0805CS  [0805 Phototransistor]  (value not drawn)
Q482  PT0805CS  [0805 Phototransistor]  (value not drawn)
Q483  PT0805CS  [0805 Phototransistor]  (value not drawn)
Q484  PT0805CS  [0805 Phototransistor]  (value not drawn)
Q485  PT0805CS  [0805 Phototransistor]  (value not drawn)
Q486  PT0805CS  [0805 Phototransistor]  (value not drawn)
Q487  PT0805CS  [0805 Phototransistor]  (value not drawn)
Q488  PT0805CS  [0805 Phototransistor]  (value not drawn)
Q489  PT0805CS  [0805 Phototransistor]  (value not drawn)
Q490  PT0805CS  [0805 Phototransistor]  (value not drawn)
Q491  PT0805CS  [0805 Phototransistor]  (value not drawn)
Q492  PT0805CS  [0805 Phototransistor]  (value not drawn)
Q493  PT0805CS  [0805 Phototransistor]  (value not drawn)
Q494  PT0805CS  [0805 Phototransistor]  (value not drawn)
Q495  PT0805CS  [0805 Phototransistor]  (value not drawn)
Q496  PT0805CS  [0805 Phototransistor]  (value not drawn)
Q497  PT0805CS  [0805 Phototransistor]  (value not drawn)
Q498  PT0805CS  [0805 Phototransistor]  (value not drawn)
Q499  PT0805CS  [0805 Phototransistor]  (value not drawn)
Q500  PT0805CS  [0805 Phototransistor]  (value not drawn)
Q501  PT0805CS  [0805 Phototransistor]  (value not drawn)
Q502  PT0805CS  [0805 Phototransistor]  (value not drawn)
Q503  PT0805CS  [0805 Phototransistor]  (value not drawn)
Q504  PT0805CS  [0805 Phototransistor]  (value not drawn)
Q505  PT0805CS  [0805 Phototransistor]  (value not drawn)
Q506  PT0805CS  [0805 Phototransistor]  (value not drawn)
Q507  PT0805CS  [0805 Phototransistor]  (value not drawn)
Q508  PT0805CS  [0805 Phototransistor]  (value not drawn)
Q509  PT0805CS  [0805 Phototransistor]  (value not drawn)
Q510  PT0805CS  [0805 Phototransistor]  (value not drawn)
Q511  PT0805CS  [0805 Phototransistor]  (value not drawn)
Q512  PT0805CS  [0805 Phototransistor]  (value not drawn)
Q513  PT0805CS  [0805 Phototransistor]  (value not drawn)
Q514  PT0805CS  [0805 Phototransistor]  (value not drawn)
Q515  PT0805CS  [0805 Phototransistor]  (value not drawn)
Q516  PT0805CS  [0805 Phototransistor]  (value not drawn)
Q517  PT0805CS  [0805 Phototransistor]  (value not drawn)
Q518  PT0805CS  [0805 Phototransistor]  (value not drawn)
Q519  PT0805CS  [0805 Phototransistor]  (value not drawn)
Q520  PT0805CS  [0805 Phototransistor]  (value not drawn)
Q521  PT0805CS  [0805 Phototransistor]  (value not drawn)
Q522  PT0805CS  [0805 Phototransistor]  (value not drawn)
Q523  PT0805CS  [0805 Phototransistor]  (value not drawn)
Q524  PT0805CS  [0805 Phototransistor]  (value not drawn)
Q525  PT0805CS  [0805 Phototransistor]  (value not drawn)
Q526  PT0805CS  [0805 Phototransistor]  (value not drawn)
Q527  PT0805CS  [0805 Phototransistor]  (value not drawn)
Q528  PT0805CS  [0805 Phototransistor]  (value not drawn)
Q529  PT0805CS  [0805 Phototransistor]  (value not drawn)
Q530  PT0805CS  [0805 Phototransistor]  (value not drawn)
Q531  PT0805CS  [0805 Phototransistor]  (value not drawn)
Q532  PT0805CS  [0805 Phototransistor]  (value not drawn)
Q533  PT0805CS  [0805 Phototransistor]  (value not drawn)
Q534  PT0805CS  [0805 Phototransistor]  (value not drawn)
Q535  PT0805CS  [0805 Phototransistor]  (value not drawn)
Q536  PT0805CS  [0805 Phototransistor]  (value not drawn)
Q537  PT0805CS  [0805 Phototransistor]  (value not drawn)
Q538  PT0805CS  [0805 Phototransistor]  (value not drawn)
Q539  PT0805CS  [0805 Phototransistor]  (value not drawn)
Q540  PT0805CS  [0805 Phototransistor]  (value not drawn)
Q541  PT0805CS  [0805 Phototransistor]  (value not drawn)
Q542  PT0805CS  [0805 Phototransistor]  (value not drawn)
Q543  PT0805CS  [0805 Phototransistor]  (value not drawn)
Q544  PT0805CS  [0805 Phototransistor]  (value not drawn)
Q545  PT0805CS  [0805 Phototransistor]  (value not drawn)
Q546  PT0805CS  [0805 Phototransistor]  (value not drawn)
Q547  PT0805CS  [0805 Phototransistor]  (value not drawn)
Q548  PT0805CS  [0805 Phototransistor]  (value not drawn)
Q549  PT0805CS  [0805 Phototransistor]  (value not drawn)
Q550  PT0805CS  [0805 Phototransistor]  (value not drawn)
Q551  PT0805CS  [0805 Phototransistor]  (value not drawn)
Q552  PT0805CS  [0805 Phototransistor]  (value not drawn)
Q553  PT0805CS  [0805 Phototransistor]  (value not drawn)
Q554  PT0805CS  [0805 Phototransistor]  (value not drawn)
Q555  PT0805CS  [0805 Phototransistor]  (value not drawn)
Q556  PT0805CS  [0805 Phototransistor]  (value not drawn)
Q557  PT0805CS  [0805 Phototransistor]  (value not drawn)
Q558  PT0805CS  [0805 Phototransistor]  (value not drawn)
Q559  PT0805CS  [0805 Phototransistor]  (value not drawn)
Q560  PT0805CS  [0805 Phototransistor]  (value not drawn)
Q561  PT0805CS  [0805 Phototransistor]  (value not drawn)
Q562  PT0805CS  [0805 Phototransistor]  (value not drawn)
Q563  PT0805CS  [0805 Phototransistor]  (value not drawn)
Q564  PT0805CS  [0805 Phototransistor]  (value not drawn)
Q565  PT0805CS  [0805 Phototransistor]  (value not drawn)
Q566  PT0805CS  [0805 Phototransistor]  (value not drawn)
Q567  PT0805CS  [0805 Phototransistor]  (value not drawn)
Q568  PT0805CS  [0805 Phototransistor]  (value not drawn)
Q569  PT0805CS  [0805 Phototransistor]  (value not drawn)
Q570  PT0805CS  [0805 Phototransistor]  (value not drawn)
Q571  PT0805CS  [0805 Phototransistor]  (value not drawn)
Q572  PT0805CS  [0805 Phototransistor]  (value not drawn)
Q573  PT0805CS  [0805 Phototransistor]  (value not drawn)
Q574  PT0805CS  [0805 Phototransistor]  (value not drawn)
Q575  PT0805CS  [0805 Phototransistor]  (value not drawn)
Q576  PT0805CS  [0805 Phototransistor]  (value not drawn)
Q577  PT0805CS  [0805 Phototransistor]  (value not drawn)
Q578  PT0805CS  [0805 Phototransistor]  (value not drawn)
Q579  PT0805CS  [0805 Phototransistor]  (value not drawn)
Q580  PT0805CS  [0805 Phototransistor]  (value not drawn)
Q581  PT0805CS  [0805 Phototransistor]  (value not drawn)
Q582  PT0805CS  [0805 Phototransistor]  (value not drawn)
Q583  PT0805CS  [0805 Phototransistor]  (value not drawn)
Q584  PT0805CS  [0805 Phototransistor]  (value not drawn)
Q585  PT0805CS  [0805 Phototransistor]  (value not drawn)
Q586  PT0805CS  [0805 Phototransistor]  (value not drawn)
Q587  PT0805CS  [0805 Phototransistor]  (value not drawn)
Q588  PT0805CS  [0805 Phototransistor]  (value not drawn)
Q589  PT0805CS  [0805 Phototransistor]  (value not drawn)
Q590  PT0805CS  [0805 Phototransistor]  (value not drawn)
Q591  PT0805CS  [0805 Phototransistor]  (value not drawn)
Q592  PT0805CS  [0805 Phototransistor]  (value not drawn)
Q593  PT0805CS  [0805 Phototransistor]  (value not drawn)
Q594  PT0805CS  [0805 Phototransistor]  (value not drawn)
Q595  PT0805CS  [0805 Phototransistor]  (value not drawn)
Q596  PT0805CS  [0805 Phototransistor]  (value not drawn)
Q597  PT0805CS  [0805 Phototransistor]  (value not drawn)
Q598  PT0805CS  [0805 Phototransistor]  (value not drawn)
Q599  PT0805CS  [0805 Phototransistor]  (value not drawn)
Q600  PT0805CS  [0805 Phototransistor]  (value not drawn)
Q601  PT0805CS  [0805 Phototransistor]  (value not drawn)
Q602  PT0805CS  [0805 Phototransistor]  (value not drawn)
Q603  PT0805CS  [0805 Phototransistor]  (value not drawn)
Q604  PT0805CS  [0805 Phototransistor]  (value not drawn)
Q605  PT0805CS  [0805 Phototransistor]  (value not drawn)
Q606  PT0805CS  [0805 Phototransistor]  (value not drawn)
Q607  PT0805CS  [0805 Phototransistor]  (value not drawn)
Q608  PT0805CS  [0805 Phototransistor]  (value not drawn)
Q609  PT0805CS  [0805 Phototransistor]  (value not drawn)
Q610  PT0805CS  [0805 Phototransistor]  (value not drawn)
Q611  PT0805CS  [0805 Phototransistor]  (value not drawn)
Q612  PT0805CS  [0805 Phototransistor]  (value not drawn)
Q613  PT0805CS  [0805 Phototransistor]  (value not drawn)
Q614  PT0805CS  [0805 Phototransistor]  (value not drawn)
Q615  PT0805CS  [0805 Phototransistor]  (value not drawn)
Q616  PT0805CS  [0805 Phototransistor]  (value not drawn)
Q617  PT0805CS  [0805 Phototransistor]  (value not drawn)
Q618  PT0805CS  [0805 Phototransistor]  (value not drawn)
Q619  PT0805CS  [0805 Phototransistor]  (value not drawn)
Q620  PT0805CS  [0805 Phototransistor]  (value not drawn)
Q621  PT0805CS  [0805 Phototransistor]  (value not drawn)
Q622  PT0805CS  [0805 Phototransistor]  (value not drawn)
Q623  PT0805CS  [0805 Phototransistor]  (value not drawn)
Q624  PT0805CS  [0805 Phototransistor]  (value not drawn)
Q625  PT0805CS  [0805 Phototransistor]  (value not drawn)
Q626  PT0805CS  [0805 Phototransistor]  (value not drawn)
Q627  PT0805CS  [0805 Phototransistor]  (value not drawn)
Q628  PT0805CS  [0805 Phototransistor]  (value not drawn)
Q629  PT0805CS  [0805 Phototransistor]  (value not drawn)
Q630  PT0805CS  [0805 Phototransistor]  (value not drawn)
Q631  PT0805CS  [0805 Phototransistor]  (value not drawn)
Q632  PT0805CS  [0805 Phototransistor]  (value not drawn)
Q633  PT0805CS  [0805 Phototransistor]  (value not drawn)
Q634  PT0805CS  [0805 Phototransistor]  (value not drawn)
Q635  PT0805CS  [0805 Phototransistor]  (value not drawn)
Q636  PT0805CS  [0805 Phototransistor]  (value not drawn)
Q637  PT0805CS  [0805 Phototransistor]  (value not drawn)
Q638  PT0805CS  [0805 Phototransistor]  (value not drawn)
Q639  PT0805CS  [0805 Phototransistor]  (value not drawn)
Q640  PT0805CS  [0805 Phototransistor]  (value not drawn)
Q641  PT0805CS  [0805 Phototransistor]  (value not drawn)
Q642  PT0805CS  [0805 Phototransistor]  (value not drawn)
Q643  PT0805CS  [0805 Phototransistor]  (value not drawn)
Q644  PT0805CS  [0805 Phototransistor]  (value not drawn)
Q645  PT0805CS  [0805 Phototransistor]  (value not drawn)
Q646  PT0805CS  [0805 Phototransistor]  (value not drawn)
Q647  PT0805CS  [0805 Phototransistor]  (value not drawn)
Q648  PT0805CS  [0805 Phototransistor]  (value not drawn)
Q649  PT0805CS  [0805 Phototransistor]  (value not drawn)
Q650  PT0805CS  [0805 Phototransistor]  (value not drawn)
Q651  PT0805CS  [0805 Phototransistor]  (value not drawn)
Q652  PT0805CS  [0805 Phototransistor]  (value not drawn)
Q653  PT0805CS  [0805 Phototransistor]  (value not drawn)
Q654  PT0805CS  [0805 Phototransistor]  (value not drawn)
Q655  PT0805CS  [0805 Phototransistor]  (value not drawn)
Q656  PT0805CS  [0805 Phototransistor]  (value not drawn)
Q657  PT0805CS  [0805 Phototransistor]  (value not drawn)
Q658  PT0805CS  [0805 Phototransistor]  (value not drawn)
Q659  PT0805CS  [0805 Phototransistor]  (value not drawn)
Q660  PT0805CS  [0805 Phototransistor]  (value not drawn)
Q661  PT0805CS  [0805 Phototransistor]  (value not drawn)
Q662  PT0805CS  [0805 Phototransistor]  (value not drawn)
Q663  PT0805CS  [0805 Phototransistor]  (value not drawn)
Q664  PT0805CS  [0805 Phototransistor]  (value not drawn)
Q665  PT0805CS  [0805 Phototransistor]  (value not drawn)
Q666  PT0805CS  [0805 Phototransistor]  (value not drawn)
Q667  PT0805CS  [0805 Phototransistor]  (value not drawn)
Q668  PT0805CS  [0805 Phototransistor]  (value not drawn)
Q669  PT0805CS  [0805 Phototransistor]  (value not drawn)
Q670  PT0805CS  [0805 Phototransistor]  (value not drawn)
Q671  PT0805CS  [0805 Phototransistor]  (value not drawn)
Q672  PT0805CS  [0805 Phototransistor]  (value not drawn)
Q673  PT0805CS  [0805 Phototransistor]  (value not drawn)
Q674  PT0805CS  [0805 Phototransistor]  (value not drawn)
Q675  PT0805CS  [0805 Phototransistor]  (value not drawn)
Q676  PT0805CS  [0805 Phototransistor]  (value not drawn)
Q677  PT0805CS  [0805 Phototransistor]  (value not drawn)
Q678  PT0805CS  [0805 Phototransistor]  (value not drawn)
Q679  PT0805CS  [0805 Phototransistor]  (value not drawn)
Q680  PT0805CS  [0805 Phototransistor]  (value not drawn)
Q681  PT0805CS  [0805 Phototransistor]  (value not drawn)
Q682  PT0805CS  [0805 Phototransistor]  (value not drawn)
Q683  PT0805CS  [0805 Phototransistor]  (value not drawn)
Q684  PT0805CS  [0805 Phototransistor]  (value not drawn)
Q685  PT0805CS  [0805 Phototransistor]  (value not drawn)
Q686  PT0805CS  [0805 Phototransistor]  (value not drawn)
Q687  PT0805CS  [0805 Phototransistor]  (value not drawn)
Q688  PT0805CS  [0805 Phototransistor]  (value not drawn)
Q689  PT0805CS  [0805 Phototransistor]  (value not drawn)
Q690  PT0805CS  [0805 Phototransistor]  (value not drawn)
Q691  PT0805CS  [0805 Phototransistor]  (value not drawn)
Q692  PT0805CS  [0805 Phototransistor]  (value not drawn)
Q693  PT0805CS  [0805 Phototransistor]  (value not drawn)
Q694  PT0805CS  [0805 Phototransistor]  (value not drawn)
Q695  PT0805CS  [0805 Phototransistor]  (value not drawn)
Q696  PT0805CS  [0805 Phototransistor]  (value not drawn)
Q697  PT0805CS  [0805 Phototransistor]  (value not drawn)
Q698  PT0805CS  [0805 Phototransistor]  (value not drawn)
Q699  PT0805CS  [0805 Phototransistor]  (value not drawn)
Q700  PT0805CS  [0805 Phototransistor]  (value not drawn)
Q701  PT0805CS  [0805 Phototransistor]  (value not drawn)
Q702  PT0805CS  [0805 Phototransistor]  (value not drawn)
Q703  PT0805CS  [0805 Phototransistor]  (value not drawn)
Q704  PT0805CS  [0805 Phototransistor]  (value not drawn)
Q705  PT0805CS  [0805 Phototransistor]  (value not drawn)
Q706  PT0805CS  [0805 Phototransistor]  (value not drawn)
Q707  PT0805CS  [0805 Phototransistor]  (value not drawn)
Q708  PT0805CS  [0805 Phototransistor]  (value not drawn)
Q709  PT0805CS  [0805 Phototransistor]  (value not drawn)
Q710  PT0805CS  [0805 Phototransistor]  (value not drawn)
Q711  PT0805CS  [0805 Phototransistor]  (value not drawn)
Q712  PT0805CS  [0805 Phototransistor]  (value not drawn)
Q713  PT0805CS  [0805 Phototransistor]  (value not drawn)
Q714  PT0805CS  [0805 Phototransistor]  (value not drawn)
Q715  PT0805CS  [0805 Phototransistor]  (value not drawn)
Q716  PT0805CS  [0805 Phototransistor]  (value not drawn)
Q717  PT0805CS  [0805 Phototransistor]  (value not drawn)
Q718  PT0805CS  [0805 Phototransistor]  (value not drawn)
Q719  PT0805CS  [0805 Phototransistor]  (value not drawn)
Q720  PT0805CS  [0805 Phototransistor]  (value not drawn)
Q721  PT0805CS  [0805 Phototransistor]  (value not drawn)
Q722  PT0805CS  [0805 Phototransistor]  (value not drawn)
Q723  PT0805CS  [0805 Phototransistor]  (value not drawn)
Q724  PT0805CS  [0805 Phototransistor]  (value not drawn)
Q725  PT0805CS  [0805 Phototransistor]  (value not drawn)
Q726  PT0805CS  [0805 Phototransistor]  (value not drawn)
Q727  PT0805CS  [0805 Phototransistor]  (value not drawn)
Q728  PT0805CS  [0805 Phototransistor]  (value not drawn)
Q729  PT0805CS  [0805 Phototransistor]  (value not drawn)
Q730  PT0805CS  [0805 Phototransistor]  (value not drawn)
Q731  PT0805CS  [0805 Phototransistor]  (value not drawn)
Q732  PT0805CS  [0805 Phototransistor]  (value not drawn)
Q733  PT0805CS  [0805 Phototransistor]  (value not drawn)
Q734  PT0805CS  [0805 Phototransistor]  (value not drawn)
Q735  PT0805CS  [0805 Phototransistor]  (value not drawn)
Q736  PT0805CS  [0805 Phototransistor]  (value not drawn)
Q737  PT0805CS  [0805 Phototransistor]  (value not drawn)
Q738  PT0805CS  [0805 Phototransistor]  (value not drawn)
Q739  PT0805CS  [0805 Phototransistor]  (value not drawn)
Q740  PT0805CS  [0805 Phototransistor]  (value not drawn)
Q741  PT0805CS  [0805 Phototransistor]  (value not drawn)
Q742  PT0805CS  [0805 Phototransistor]  (value not drawn)
Q743  PT0805CS  [0805 Phototransistor]  (value not drawn)
Q744  PT0805CS  [0805 Phototransistor]  (value not drawn)
Q745  PT0805CS  [0805 Phototransistor]  (value not drawn)
Q746  PT0805CS  [0805 Phototransistor]  (value not drawn)
Q747  PT0805CS  [0805 Phototransistor]  (value not drawn)
Q748  PT0805CS  [0805 Phototransistor]  (value not drawn)
Q749  PT0805CS  [0805 Phototransistor]  (value not drawn)
Q750  PT0805CS  [0805 Phototransistor]  (value not drawn)
Q751  PT0805CS  [0805 Phototransistor]  (value not drawn)
Q752  PT0805CS  [0805 Phototransistor]  (value not drawn)
Q753  PT0805CS  [0805 Phototransistor]  (value not drawn)
Q754  PT0805CS  [0805 Phototransistor]  (value not drawn)
Q755  PT0805CS  [0805 Phototransistor]  (value not drawn)
Q756  PT0805CS  [0805 Phototransistor]  (value not drawn)
Q757  PT0805CS  [0805 Phototransistor]  (value not drawn)
Q758  PT0805CS  [0805 Phototransistor]  (value not drawn)
Q759  PT0805CS  [0805 Phototransistor]  (value not drawn)
Q760  PT0805CS  [0805 Phototransistor]  (value not drawn)
Q761  PT0805CS  [0805 Phototransistor]  (value not drawn)
Q762  PT0805CS  [0805 Phototransistor]  (value not drawn)
Q763  PT0805CS  [0805 Phototransistor]  (value not drawn)
Q764  PT0805CS  [0805 Phototransistor]  (value not drawn)
Q765  PT0805CS  [0805 Phototransistor]  (value not drawn)
Q766  PT0805CS  [0805 Phototransistor]  (value not drawn)
Q767  PT0805CS  [0805 Phototransistor]  (value not drawn)
Q768  PT0805CS  [0805 Phototransistor]  (value not drawn)
Q769  PT0805CS  [0805 Phototransistor]  (value not drawn)
Q770  PT0805CS  [0805 Phototransistor]  (value not drawn)
Q771  PT0805CS  [0805 Phototransistor]  (value not drawn)
Q772  PT0805CS  [0805 Phototransistor]  (value not drawn)
Q773  PT0805CS  [0805 Phototransistor]  (value not drawn)
Q774  PT0805CS  [0805 Phototransistor]  (value not drawn)
Q775  PT0805CS  [0805 Phototransistor]  (value not drawn)
Q776  PT0805CS  [0805 Phototransistor]  (value not drawn)
Q777  PT0805CS  [0805 Phototransistor]  (value not drawn)
Q778  PT0805CS  [0805 Phototransistor]  (value not drawn)
Q779  PT0805CS  [0805 Phototransistor]  (value not drawn)
Q780  PT0805CS  [0805 Phototransistor]  (value not drawn)
Q781  PT0805CS  [0805 Phototransistor]  (value not drawn)
Q782  PT0805CS  [0805 Phototransistor]  (value not drawn)
Q783  PT0805CS  [0805 Phototransistor]  (value not drawn)
Q784  PT0805CS  [0805 Phototransistor]  (value not drawn)
Q785  PT0805CS  [0805 Phototransistor]  (value not drawn)
Q786  PT0805CS  [0805 Phototransistor]  (value not drawn)
Q787  PT0805CS  [0805 Phototransistor]  (value not drawn)
Q788  PT0805CS  [0805 Phototransistor]  (value not drawn)
Q789  PT0805CS  [0805 Phototransistor]  (value not drawn)
Q790  PT0805CS  [0805 Phototransistor]  (value not drawn)
Q791  PT0805CS  [0805 Phototransistor]  (value not drawn)
Q792  PT0805CS  [0805 Phototransistor]  (value not drawn)
Q793  PT0805CS  [0805 Phototransistor]  (value not drawn)
Q794  PT0805CS  [0805 Phototransistor]  (value not drawn)
Q795  PT0805CS  [0805 Phototransistor]  (value not drawn)
Q796  PT0805CS  [0805 Phototransistor]  (value not drawn)
Q797  PT0805CS  [0805 Phototransistor]  (value not drawn)
Q798  PT0805CS  [0805 Phototransistor]  (value not drawn)
Q799  PT0805CS  [0805 Phototransistor]  (value not drawn)
Q800  PT0805CS  [0805 Phototransistor]  (value not drawn)
Q801  PT0805CS  [0805 Phototransistor]  (value not drawn)
Q802  PT0805CS  [0805 Phototransistor]  (value not drawn)
Q803  PT0805CS  [0805 Phototransistor]  (value not drawn)
Q804  PT0805CS  [0805 Phototransistor]  (value not drawn)
Q805  PT0805CS  [0805 Phototransistor]  (value not drawn)
Q806  PT0805CS  [0805 Phototransistor]  (value not drawn)
Q807  PT0805CS  [0805 Phototransistor]  (value not drawn)
Q808  PT0805CS  [0805 Phototransistor]  (value not drawn)
Q809  PT0805CS  [0805 Phototransistor]  (value not drawn)
Q810  PT0805CS  [0805 Phototransistor]  (value not drawn)
Q811  PT0805CS  [0805 Phototransistor]  (value not drawn)
Q812  PT0805CS  [0805 Phototransistor]  (value not drawn)
Q813  PT0805CS  [0805 Phototransistor]  (value not drawn)
Q814  PT0805CS  [0805 Phototransistor]  (value not drawn)
Q815  PT0805CS  [0805 Phototransistor]  (value not drawn)
Q816  PT0805CS  [0805 Phototransistor]  (value not drawn)
Q817  PT0805CS  [0805 Phototransistor]  (value not drawn)
Q818  PT0805CS  [0805 Phototransistor]  (value not drawn)
Q819  PT0805CS  [0805 Phototransistor]  (value not drawn)
Q820  PT0805CS  [0805 Phototransistor]  (value not drawn)
Q821  PT0805CS  [0805 Phototransistor]  (value not drawn)
Q822  PT0805CS  [0805 Phototransistor]  (value not drawn)
Q823  PT0805CS  [0805 Phototransistor]  (value not drawn)
Q824  PT0805CS  [0805 Phototransistor]  (value not drawn)
Q825  PT0805CS  [0805 Phototransistor]  (value not drawn)
Q826  PT0805CS  [0805 Phototransistor]  (value not drawn)
Q827  PT0805CS  [0805 Phototransistor]  (value not drawn)
Q828  PT0805CS  [0805 Phototransistor]  (value not drawn)
Q829  PT0805CS  [0805 Phototransistor]  (value not drawn)
Q830  PT0805CS  [0805 Phototransistor]  (value not drawn)
Q831  PT0805CS  [0805 Phototransistor]  (value not drawn)
Q832  PT0805CS  [0805 Phototransistor]  (value not drawn)
Q833  PT0805CS  [0805 Phototransistor]  (value not drawn)
Q834  PT0805CS  [0805 Phototransistor]  (value not drawn)
Q835  PT0805CS  [0805 Phototransistor]  (value not drawn)
Q836  PT0805CS  [0805 Phototransistor]  (value not drawn)
Q837  PT0805CS  [0805 Phototransistor]  (value not drawn)
Q838  PT0805CS  [0805 Phototransistor]  (value not drawn)
Q839  PT0805CS  [0805 Phototransistor]  (value not drawn)
Q840  PT0805CS  [0805 Phototransistor]  (value not drawn)
Q841  PT0805CS  [0805 Phototransistor]  (value not drawn)
Q842  PT0805CS  [0805 Phototransistor]  (value not drawn)
Q843  PT0805CS  [0805 Phototransistor]  (value not drawn)
Q844  PT0805CS  [0805 Phototransistor]  (value not drawn)
Q845  PT0805CS  [0805 Phototransistor]  (value not drawn)
Q846  PT0805CS  [0805 Phototransistor]  (value not drawn)
Q847  PT0805CS  [0805 Phototransistor]  (value not drawn)
Q848  PT0805CS  [0805 Phototransistor]  (value not drawn)
Q849  PT0805CS  [0805 Phototransistor]  (value not drawn)
Q850  PT0805CS  [0805 Phototransistor]  (value not drawn)
Q851  PT0805CS  [0805 Phototransistor]  (value not drawn)
Q852  PT0805CS  [0805 Phototransistor]  (value not drawn)
Q853  PT0805CS  [0805 Phototransistor]  (value not drawn)
Q854  PT0805CS  [0805 Phototransistor]  (value not drawn)
Q855  PT0805CS  [0805 Phototransistor]  (value not drawn)
Q856  PT0805CS  [0805 Phototransistor]  (value not drawn)
Q857  PT0805CS  [0805 Phototransistor]  (value not drawn)
Q858  PT0805CS  [0805 Phototransistor]  (value not drawn)
Q859  PT0805CS  [0805 Phototransistor]  (value not drawn)
Q860  PT0805CS  [0805 Phototransistor]  (value not drawn)
Q861  PT0805CS  [0805 Phototransistor]  (value not drawn)
Q862  PT0805CS  [0805 Phototransistor]  (value not drawn)
Q863  PT0805CS  [0805 Phototransistor]  (value not drawn)